# EAGLE schematic Resistor_Resistor (EAGLE 8.3.0), part 6 of 43
## Parts (continued)
R7323  10K  RESISTOR_0201  [0201]
R7324  10K  RESISTOR_0201  [0201]
R7325  10K  RESISTOR_0201  [0201]
R7326  10K  RESISTOR_0201  [0201]
R7327  10K  RESISTOR_0201  [0201]
R7328  10K  RESISTOR_0201  [0201]
R7329  10K  RESISTOR_0201  [0201]
R7330  10K  RESISTOR_0201  [0201]
R7331  10K  RESISTOR_0201  [0201]
R7332  10K  RESISTOR_0201  [0201]
R7333  10K  RESISTOR_0201  [0201]
R7334  10K  RESISTOR_0201  [0201]
R7335  10K  RESISTOR_0201  [0201]
R7336  10K  RESISTOR_0201  [0201]
R7337  10K  RESISTOR_0201  [0201]
R7338  10K  RESISTOR_0201  [0201]
R7339  10K  RESISTOR_0201  [0201]
R7340  10K  RESISTOR_0201  [0201]
R7341  10K  RESISTOR_0201  [0201]
R7342  10K  RESISTOR_0201  [0201]
R7343  10K  RESISTOR_0201  [0201]
R7344  10K  RESISTOR_0201  [0201]
R7345  10K  RESISTOR_0201  [0201]
R7346  10K  RESISTOR_0201  [0201]
R7347  10K  RESISTOR_0201  [0201]
R7348  10K  RESISTOR_0201  [0201]
R7349  10K  RESISTOR_0201  [0201]
R7350  10K  RESISTOR_0201  [0201]
R7351  10K  RESISTOR_0201  [0201]
R7352  10K  RESISTOR_0201  [0201]
R7353  10K  RESISTOR_0201  [0201]
R7354  10K  RESISTOR_0201  [0201]
R7355  10K  RESISTOR_0201  [0201]
R7356  10K  RESISTOR_0201  [0201]
R7357  10K  RESISTOR_0201  [0201]
R7358  10K  RESISTOR_0201  [0201]
R7359  10K  RESISTOR_0201  [0201]
R7360  10K  RESISTOR_0201  [0201]
R7361  10K  RESISTOR_0201  [0201]
R7362  10K  RESISTOR_0201  [0201]
R7363  10K  RESISTOR_0201  [0201]
R7364  10K  RESISTOR_0201  [0201]
R7365  10K  RESISTOR_0201  [0201]
R7366  10K  RESISTOR_0201  [0201]
R7367  10K  RESISTOR_0201  [0201]
R7368  10K  RESISTOR_0201  [0201]
R7369  10K  RESISTOR_0201  [0201]
R7370  10K  RESISTOR_0201  [0201]
R7371  10K  RESISTOR_0201  [0201]
R7372  10K  RESISTOR_0201  [0201]
R7373  10K  RESISTOR_0201  [0201]
R7374  10K  RESISTOR_0201  [0201]
R7375  10K  RESISTOR_0201  [0201]
R7376  10K  RESISTOR_0201  [0201]
R7377  10K  RESISTOR_0201  [0201]
R7378  10K  RESISTOR_0201  [0201]
R7379  10K  RESISTOR_0201  [0201]
R7380  10K  RESISTOR_0201  [0201]
R7381  10K  RESISTOR_0201  [0201]
R7382  10K  RESISTOR_0201  [0201]
R7383  10K  RESISTOR_0201  [0201]
R7384  10K  RESISTOR_0201  [0201]
R7385  10K  RESISTOR_0201  [0201]
R7386  10K  RESISTOR_0201  [0201]
R7387  10K  RESISTOR_0201  [0201]
R7388  10K  RESISTOR_0201  [0201]
R7389  10K  RESISTOR_0201  [0201]
R7390  10K  RESISTOR_0201  [0201]
R7391  10K  RESISTOR_0201  [0201]
R7392  10K  RESISTOR_0201  [0201]
R7393  10K  RESISTOR_0201  [0201]
R7394  10K  RESISTOR_0201  [0201]
R7395  10K  RESISTOR_0201  [0201]
R7396  10K  RESISTOR_0201  [0201]
R7397  10K  RESISTOR_0201  [0201]
R7398  10K  RESISTOR_0201  [0201]
R7399  10K  RESISTOR_0201  [0201]
R7400  10K  RESISTOR_0201  [0201]
R7401  10K  RESISTOR_0201  [0201]
R7402  10K  RESISTOR_0201  [0201]
R7403  10K  RESISTOR_0201  [0201]
R7404  10K  RESISTOR_0201  [0201]
R7405  10K  RESISTOR_0201  [0201]
R7406  10K  RESISTOR_0201  [0201]
R7407  10K  RESISTOR_0201  [0201]
R7408  10K  RESISTOR_0201  [0201]
R7409  10K  RESISTOR_0201  [0201]
R7410  10K  RESISTOR_0201  [0201]
R7411  10K  RESISTOR_0201  [0201]
R7412  10K  RESISTOR_0201  [0201]
R7413  10K  RESISTOR_0201  [0201]
R7414  10K  RESISTOR_0201  [0201]
R7415  10K  RESISTOR_0201  [0201]
R7416  10K  RESISTOR_0201  [0201]
R7417  10K  RESISTOR_0201  [0201]
R7418  10K  RESISTOR_0201  [0201]
R7419  10K  RESISTOR_0201  [0201]
R7420  10K  RESISTOR_0201  [0201]
R7421  10K  RESISTOR_0201  [0201]
R7422  10K  RESISTOR_0201  [0201]
R7423  10K  RESISTOR_0201  [0201]
R7424  10K  RESISTOR_0201  [0201]
R7425  10K  RESISTOR_0201  [0201]
R7426  10K  RESISTOR_0201  [0201]
R7427  10K  RESISTOR_0201  [0201]
R7428  10K  RESISTOR_0201  [0201]
R7429  10K  RESISTOR_0201  [0201]
R7430  10K  RESISTOR_0201  [0201]
R7431  10K  RESISTOR_0201  [0201]
R7432  10K  RESISTOR_0201  [0201]
R7433  10K  RESISTOR_0201  [0201]
R7434  10K  RESISTOR_0201  [0201]
R7435  10K  RESISTOR_0201  [0201]
R7436  10K  RESISTOR_0201  [0201]
R7437  10K  RESISTOR_0201  [0201]
R7438  10K  RESISTOR_0201  [0201]
R7439  10K  RESISTOR_0201  [0201]
R7440  10K  RESISTOR_0201  [0201]
R7441  10K  RESISTOR_0201  [0201]
R7442  10K  RESISTOR_0201  [0201]
R7443  10K  RESISTOR_0201  [0201]
R7444  10K  RESISTOR_0201  [0201]
R7445  10K  RESISTOR_0201  [0201]
R7446  10K  RESISTOR_0201  [0201]
R7447  10K  RESISTOR_0201  [0201]
R7448  10K  RESISTOR_0201  [0201]
R7449  10K  RESISTOR_0201  [0201]
R7450  10K  RESISTOR_0201  [0201]
R7451  10K  RESISTOR_0201  [0201]
R7452  10K  RESISTOR_0201  [0201]
R7453  10K  RESISTOR_0201  [0201]
R7454  10K  RESISTOR_0201  [0201]
R7455  10K  RESISTOR_0201  [0201]
R7456  10K  RESISTOR_0201  [0201]
R7457  10K  RESISTOR_0201  [0201]
R7458  10K  RESISTOR_0201  [0201]
R7459  10K  RESISTOR_0201  [0201]
R7460  10K  RESISTOR_0201  [0201]
R7461  10K  RESISTOR_0201  [0201]
R7462  10K  RESISTOR_0201  [0201]
R7463  10K  RESISTOR_0201  [0201]
R7464  10K  RESISTOR_0201  [0201]
R7465  10K  RESISTOR_0201  [0201]
R7466  10K  RESISTOR_0201  [0201]
R7467  10K  RESISTOR_0201  [0201]
R7468  10K  RESISTOR_0201  [0201]
R7469  10K  RESISTOR_0201  [0201]
R7470  10K  RESISTOR_0201  [0201]
R7471  10K  RESISTOR_0201  [0201]
R7472  10K  RESISTOR_0201  [0201]
R7473  10K  RESISTOR_0201  [0201]
R7474  10K  RESISTOR_0201  [0201]
R7475  10K  RESISTOR_0201  [0201]
R7476  10K  RESISTOR_0201  [0201]
R7477  10K  RESISTOR_0201  [0201]
R7478  10K  RESISTOR_0201  [0201]
R7479  10K  RESISTOR_0201  [0201]
R7480  10K  RESISTOR_0201  [0201]
R7481  10K  RESISTOR_0201  [0201]
R7482  10K  RESISTOR_0201  [0201]
R7483  10K  RESISTOR_0201  [0201]
R7484  10K  RESISTOR_0201  [0201]
R7485  10K  RESISTOR_0201  [0201]
R7486  10K  RESISTOR_0201  [0201]
R7487  10K  RESISTOR_0201  [0201]
R7488  10K  RESISTOR_0201  [0201]
R7489  10K  RESISTOR_0201  [0201]
R7490  10K  RESISTOR_0201  [0201]
R7491  10K  RESISTOR_0201  [0201]
R7492  10K  RESISTOR_0201  [0201]
R7493  10K  RESISTOR_0201  [0201]
R7494  10K  RESISTOR_0201  [0201]
R7495  10K  RESISTOR_0201  [0201]
R7496  10K  RESISTOR_0201  [0201]
R7497  10K  RESISTOR_0201  [0201]
R7498  10K  RESISTOR_0201  [0201]
R7499  10K  RESISTOR_0201  [0201]
R7500  10K  RESISTOR_0201  [0201]
R7501  10K  RESISTOR_0201  [0201]
R7502  10K  RESISTOR_0201  [0201]
R7503  10K  RESISTOR_0201  [0201]
R7504  10K  RESISTOR_0201  [0201]
R7505  10K  RESISTOR_0201  [0201]
R7506  10K  RESISTOR_0201  [0201]
R7507  10K  RESISTOR_0201  [0201]
R7508  10K  RESISTOR_0201  [0201]
R7509  10K  RESISTOR_0201  [0201]
R7510  10K  RESISTOR_0201  [0201]
R7511  10K  RESISTOR_0201  [0201]
R7512  10K  RESISTOR_0201  [0201]
R7513  10K  RESISTOR_0201  [0201]
R7514  10K  RESISTOR_0201  [0201]
R7515  10K  RESISTOR_0201  [0201]
R7516  10K  RESISTOR_0201  [0201]
R7517  10K  RESISTOR_0201  [0201]
R7518  10K  RESISTOR_0201  [0201]
R7519  10K  RESISTOR_0201  [0201]
R7520  10K  RESISTOR_0201  [0201]
R7521  10K  RESISTOR_0201  [0201]
R7522  10K  RESISTOR_0201  [0201]
R7523  10K  RESISTOR_0201  [0201]
R7524  10K  RESISTOR_0201  [0201]
R7525  10K  RESISTOR_0201  [0201]
R7526  10K  RESISTOR_0201  [0201]
R7527  10K  RESISTOR_0201  [0201]
R7528  10K  RESISTOR_0201  [0201]
R7529  10K  RESISTOR_0201  [0201]
R7530  10K  RESISTOR_0201  [0201]
R7531  10K  RESISTOR_0201  [0201]
R7532  10K  RESISTOR_0201  [0201]
R7533  10K  RESISTOR_0201  [0201]
R7534  10K  RESISTOR_0201  [0201]
R7535  10K  RESISTOR_0201  [0201]
R7536  10K  RESISTOR_0201  [0201]
R7537  10K  RESISTOR_0201  [0201]
R7538  10K  RESISTOR_0201  [0201]
R7539  10K  RESISTOR_0201  [0201]
R7540  10K  RESISTOR_0201  [0201]
R7541  10K  RESISTOR_0201  [0201]
R7542  10K  RESISTOR_0201  [0201]
R7543  10K  RESISTOR_0201  [0201]
R7544  10K  RESISTOR_0201  [0201]
R7545  10K  RESISTOR_0201  [0201]
R7546  10K  RESISTOR_0201  [0201]
R7547  10K  RESISTOR_0201  [0201]
R7548  10K  RESISTOR_0201  [0201]
R7549  10K  RESISTOR_0201  [0201]
R7550  10K  RESISTOR_0201  [0201]
R7551  10K  RESISTOR_0201  [0201]
R7552  10K  RESISTOR_0201  [0201]
R7553  10K  RESISTOR_0201  [0201]
R7554  10K  RESISTOR_0201  [0201]
R7555  10K  RESISTOR_0201  [0201]
R7556  10K  RESISTOR_0201  [0201]
R7557  10K  RESISTOR_0201  [0201]
R7558  10K  RESISTOR_0201  [0201]
R7559  10K  RESISTOR_0201  [0201]
R7560  10K  RESISTOR_0201  [0201]
R7561  10K  RESISTOR_0201  [0201]
R7562  10K  RESISTOR_0201  [0201]
R7563  10K  RESISTOR_0201  [0201]
R7564  10K  RESISTOR_0201  [0201]
R7565  10K  RESISTOR_0201  [0201]
R7566  10K  RESISTOR_0201  [0201]
R7567  10K  RESISTOR_0201  [0201]
R7568  10K  RESISTOR_0201  [0201]
R7569  10K  RESISTOR_0201  [0201]
R7570  10K  RESISTOR_0201  [0201]
R7571  10K  RESISTOR_0201  [0201]
R7572  10K  RESISTOR_0201  [0201]
R7573  10K  RESISTOR_0201  [0201]
R7574  10K  RESISTOR_0201  [0201]
R7575  10K  RESISTOR_0201  [0201]
R7576  10K  RESISTOR_0201  [0201]
R7577  10K  RESISTOR_0201  [0201]
R7578  10K  RESISTOR_0201  [0201]
R7579  10K  RESISTOR_0201  [0201]
R7580  10K  RESISTOR_0201  [0201]
R7581  10K  RESISTOR_0201  [0201]
R7582  10K  RESISTOR_0201  [0201]
R7583  10K  RESISTOR_0201  [0201]
R7584  10K  RESISTOR_0201  [0201]
R7585  10K  RESISTOR_0201  [0201]
R7586  10K  RESISTOR_0201  [0201]
R7587  10K  RESISTOR_0201  [0201]
R7588  10K  RESISTOR_0201  [0201]
R7589  10K  RESISTOR_0201  [0201]
R7590  10K  RESISTOR_0201  [0201]
R7591  10K  RESISTOR_0201  [0201]
R7592  10K  RESISTOR_0201  [0201]
R7593  10K  RESISTOR_0201  [0201]
R7594  10K  RESISTOR_0201  [0201]
R7595  10K  RESISTOR_0201  [0201]
R7596  10K  RESISTOR_0201  [0201]
R7597  10K  RESISTOR_0201  [0201]
R7598  10K  RESISTOR_0201  [0201]
R7599  10K  RESISTOR_0201  [0201]
R7600  10K  RESISTOR_0201  [0201]
R7601  10K  RESISTOR_0201  [0201]
R7602  10K  RESISTOR_0201  [0201]
R7603  10K  RESISTOR_0201  [0201]
R7604  10K  RESISTOR_0201  [0201]
R7605  10K  RESISTOR_0201  [0201]
R7606  10K  RESISTOR_0201  [0201]
R7607  10K  RESISTOR_0201  [0201]
R7608  10K  RESISTOR_0201  [0201]
R7609  10K  RESISTOR_0201  [0201]
R7610  10K  RESISTOR_0201  [0201]
R7611  10K  RESISTOR_0201  [0201]
R7612  10K  RESISTOR_0201  [0201]
R7613  10K  RESISTOR_0201  [0201]
R7614  10K  RESISTOR_0201  [0201]
R7615  10K  RESISTOR_0201  [0201]
R7616  10K  RESISTOR_0201  [0201]
R7617  10K  RESISTOR_0201  [0201]
R7618  10K  RESISTOR_0201  [0201]
R7619  10K  RESISTOR_0201  [0201]
R7620  10K  RESISTOR_0201  [0201]
R7621  10K  RESISTOR_0201  [0201]
R7622  10K  RESISTOR_0201  [0201]
R7623  10K  RESISTOR_0201  [0201]
R7624  10K  RESISTOR_0201  [0201]
R7625  10K  RESISTOR_0201  [0201]
R7626  10K  RESISTOR_0201  [0201]
R7627  10K  RESISTOR_0201  [0201]
R7628  10K  RESISTOR_0201  [0201]
R7629  10K  RESISTOR_0201  [0201]
R7630  10K  RESISTOR_0201  [0201]
R7631  10K  RESISTOR_0201  [0201]
R7632  10K  RESISTOR_0201  [0201]
R7633  10K  RESISTOR_0201  [0201]
R7634  10K  RESISTOR_0201  [0201]
R7635  10K  RESISTOR_0201  [0201]
R7636  10K  RESISTOR_0201  [0201]
R7637  10K  RESISTOR_0201  [0201]
R7638  10K  RESISTOR_0201  [0201]
R7639  10K  RESISTOR_0201  [0201]
R7640  10K  RESISTOR_0201  [0201]
R7641  10K  RESISTOR_0201  [0201]
R7642  10K  RESISTOR_0201  [0201]
R7643  10K  RESISTOR_0201  [0201]
R7644  10K  RESISTOR_0201  [0201]
R7645  10K  RESISTOR_0201  [0201]
R7646  10K  RESISTOR_0201  [0201]
R7647  10K  RESISTOR_0201  [0201]
R7648  10K  RESISTOR_0201  [0201]
R7649  10K  RESISTOR_0201  [0201]
R7650  10K  RESISTOR_0201  [0201]
R7651  10K  RESISTOR_0201  [0201]
R7652  10K  RESISTOR_0201  [0201]
R7653  10K  RESISTOR_0201  [0201]
R7654  10K  RESISTOR_0201  [0201]
R7655  10K  RESISTOR_0201  [0201]
R7656  10K  RESISTOR_0201  [0201]
R7657  10K  RESISTOR_0201  [0201]
R7658  10K  RESISTOR_0201  [0201]
R7659  10K  RESISTOR_0201  [0201]
R7660  10K  RESISTOR_0201  [0201]
R7661  10K  RESISTOR_0201  [0201]
R7662  10K  RESISTOR_0201  [0201]
R7663  10K  RESISTOR_0201  [0201]
R7664  10K  RESISTOR_0201  [0201]
R7665  10K  RESISTOR_0201  [0201]
R7666  10K  RESISTOR_0201  [0201]
R7667  10K  RESISTOR_0201  [0201]
R7668  10K  RESISTOR_0201  [0201]
R7669  10K  RESISTOR_0201  [0201]
R7670  10K  RESISTOR_0201  [0201]
R7671  10K  RESISTOR_0201  [0201]
R7672  10K  RESISTOR_0201  [0201]
R7673  10K  RESISTOR_0201  [0201]
R7674  10K  RESISTOR_0201  [0201]
R7675  10K  RESISTOR_0201  [0201]
R7676  10K  RESISTOR_0201  [0201]
R7677  10K  RESISTOR_0201  [0201]
R7678  10K  RESISTOR_0201  [0201]
R7679  10K  RESISTOR_0201  [0201]
R7680  10K  RESISTOR_0201  [0201]
R7681  10K  RESISTOR_0201  [0201]
R7682  10K  RESISTOR_0201  [0201]
R7683  10K  RESISTOR_0201  [0201]
R7684  10K  RESISTOR_0201  [0201]
R7685  10K  RESISTOR_0201  [0201]
R7686  10K  RESISTOR_0201  [0201]
R7687  10K  RESISTOR_0201  [0201]
R7688  10K  RESISTOR_0201  [0201]
R7689  10K  RESISTOR_0201  [0201]
R7690  10K  RESISTOR_0201  [0201]
R7691  10K  RESISTOR_0201  [0201]
R7692  10K  RESISTOR_0201  [0201]
R7693  10K  RESISTOR_0201  [0201]
R7694  10K  RESISTOR_0201  [0201]
R7695  10K  RESISTOR_0201  [0201]
R7696  10K  RESISTOR_0201  [0201]
R7697  10K  RESISTOR_0201  [0201]
R7698  10K  RESISTOR_0201  [0201]
R7699  10K  RESISTOR_0201  [0201]
R7700  10K  RESISTOR_0201  [0201]
R7701  10K  RESISTOR_0201  [0201]
R7702  10K  RESISTOR_0201  [0201]
R7703  10K  RESISTOR_0201  [0201]
R7704  10K  RESISTOR_0201  [0201]
R7705  10K  RESISTOR_0201  [0201]
R7706  10K  RESISTOR_0201  [0201]
R7707  10K  RESISTOR_0201  [0201]
R7708  10K  RESISTOR_0201  [0201]
R7709  10K  RESISTOR_0201  [0201]
R7710  10K  RESISTOR_0201  [0201]
R7711  10K  RESISTOR_0201  [0201]
R7712  10K  RESISTOR_0201  [0201]
R7713  10K  RESISTOR_0201  [0201]
R7714  10K  RESISTOR_0201  [0201]
R7715  10K  RESISTOR_0201  [0201]
R7716  10K  RESISTOR_0201  [0201]
R7717  10K  RESISTOR_0201  [0201]
R7718  10K  RESISTOR_0201  [0201]
R7719  10K  RESISTOR_0201  [0201]
R7720  10K  RESISTOR_0201  [0201]
R7721  10K  RESISTOR_0201  [0201]
R7722  10K  RESISTOR_0201  [0201]
R7723  10K  RESISTOR_0201  [0201]
R7724  10K  RESISTOR_0201  [0201]
R7725  10K  RESISTOR_0201  [0201]
R7726  10K  RESISTOR_0201  [0201]
R7727  10K  RESISTOR_0201  [0201]
R7728  10K  RESISTOR_0201  [0201]
R7729  10K  RESISTOR_0201  [0201]
R7730  10K  RESISTOR_0201  [0201]
R7731  10K  RESISTOR_0201  [0201]
R7732  10K  RESISTOR_0201  [0201]
R7733  10K  RESISTOR_0201  [0201]
R7734  10K  RESISTOR_0201  [0201]
R7735  10K  RESISTOR_0201  [0201]
R7736  10K  RESISTOR_0201  [0201]
R7737  10K  RESISTOR_0201  [0201]
R7738  10K  RESISTOR_0201  [0201]
R7739  10K  RESISTOR_0201  [0201]
R7740  10K  RESISTOR_0201  [0201]
R7741  10K  RESISTOR_0201  [0201]
R7742  10K  RESISTOR_0201  [0201]
R7743  10K  RESISTOR_0201  [0201]
R7744  10K  RESISTOR_0201  [0201]
R7745  10K  RESISTOR_0201  [0201]
R7746  10K  RESISTOR_0201  [0201]
R7747  10K  RESISTOR_0201  [0201]
R7748  10K  RESISTOR_0201  [0201]
R7749  10K  RESISTOR_0201  [0201]
R7750  10K  RESISTOR_0201  [0201]
R7751  10K  RESISTOR_0201  [0201]
R7752  10K  RESISTOR_0201  [0201]
R7753  10K  RESISTOR_0201  [0201]
R7754  10K  RESISTOR_0201  [0201]
R7755  10K  RESISTOR_0201  [0201]
R7756  10K  RESISTOR_0201  [0201]
R7757  10K  RESISTOR_0201  [0201]
R7758  10K  RESISTOR_0201  [0201]
R7759  10K  RESISTOR_0201  [0201]
R7760  10K  RESISTOR_0201  [0201]
R7761  10K  RESISTOR_0201  [0201]
R7762  10K  RESISTOR_0201  [0201]
R7763  10K  RESISTOR_0201  [0201]
R7764  10K  RESISTOR_0201  [0201]
R7765  10K  RESISTOR_0201  [0201]
R7766  10K  RESISTOR_0201  [0201]
R7767  10K  RESISTOR_0201  [0201]
R7768  10K  RESISTOR_0201  [0201]
R7769  10K  RESISTOR_0201  [0201]
R7770  10K  RESISTOR_0201  [0201]
R7771  10K  RESISTOR_0201  [0201]
R7772  10K  RESISTOR_0201  [0201]
R7773  10K  RESISTOR_0201  [0201]
R7774  10K  RESISTOR_0201  [0201]
R7775  10K  RESISTOR_0201  [0201]
R7776  10K  RESISTOR_0201  [0201]
R7777  10K  RESISTOR_0201  [0201]
R7778  10K  RESISTOR_0201  [0201]
R7779  10K  RESISTOR_0201  [0201]
R7780  10K  RESISTOR_0201  [0201]
R7781  10K  RESISTOR_0201  [0201]
R7782  10K  RESISTOR_0201  [0201]
R7783  10K  RESISTOR_0201  [0201]
R7784  10K  RESISTOR_0201  [0201]
R7785  10K  RESISTOR_0201  [0201]
R7786  10K  RESISTOR_0201  [0201]
R7787  10K  RESISTOR_0201  [0201]
R7788  10K  RESISTOR_0201  [0201]
R7789  10K  RESISTOR_0201  [0201]
R7790  10K  RESISTOR_0201  [0201]
R7791  10K  RESISTOR_0201  [0201]
R7792  10K  RESISTOR_0201  [0201]
R7793  10K  RESISTOR_0201  [0201]
R7794  10K  RESISTOR_0201  [0201]
R7795  10K  RESISTOR_0201  [0201]
R7796  10K  RESISTOR_0201  [0201]
R7797  10K  RESISTOR_0201  [0201]
R7798  10K  RESISTOR_0201  [0201]
R7799  10K  RESISTOR_0201  [0201]
R7800  10K  RESISTOR_0201  [0201]
R7801  10K  RESISTOR_0201  [0201]
R7802  10K  RESISTOR_0201  [0201]
R7803  10K  RESISTOR_0201  [0201]
R7804  10K  RESISTOR_0201  [0201]
R7805  10K  RESISTOR_0201  [0201]
R7806  10K  RESISTOR_0201  [0201]
R7807  10K  RESISTOR_0201  [0201]
R7808  10K  RESISTOR_0201  [0201]
R7809  10K  RESISTOR_0201  [0201]
R7810  10K  RESISTOR_0201  [0201]
R7811  10K  RESISTOR_0201  [0201]
R7812  10K  RESISTOR_0201  [0201]
R7813  10K  RESISTOR_0201  [0201]
R7814  10K  RESISTOR_0201  [0201]
R7815  10K  RESISTOR_0201  [0201]
R7816  10K  RESISTOR_0201  [0201]
R7817  10K  RESISTOR_0201  [0201]
R7818  10K  RESISTOR_0201  [0201]
R7819  10K  RESISTOR_0201  [0201]
R7820  10K  RESISTOR_0201  [0201]
R7821  10K  RESISTOR_0201  [0201]
R7822  10K  RESISTOR_0201  [0201]
R7823  10K  RESISTOR_0201  [0201]
R7824  10K  RESISTOR_0201  [0201]
R7825  10K  RESISTOR_0201  [0201]
R7826  10K  RESISTOR_0201  [0201]
R7827  10K  RESISTOR_0201  [0201]
R7828  10K  RESISTOR_0201  [0201]
R7829  10K  RESISTOR_0201  [0201]
R7830  10K  RESISTOR_0201  [0201]
R7831  10K  RESISTOR_0201  [0201]
R7832  10K  RESISTOR_0201  [0201]
R7833  10K  RESISTOR_0201  [0201]
R7834  10K  RESISTOR_0201  [0201]
R7835  10K  RESISTOR_0201  [0201]
R7836  10K  RESISTOR_0201  [0201]
R7837  10K  RESISTOR_0201  [0201]
R7838  10K  RESISTOR_0201  [0201]
R7839  10K  RESISTOR_0201  [0201]
R7840  10K  RESISTOR_0201  [0201]
R7841  10K  RESISTOR_0201  [0201]
R7842  10K  RESISTOR_0201  [0201]
R7843  10K  RESISTOR_0201  [0201]
R7844  10K  RESISTOR_0201  [0201]
R7845  10K  RESISTOR_0201  [0201]
R7846  10K  RESISTOR_0201  [0201]
R7847  10K  RESISTOR_0201  [0201]
R7848  10K  RESISTOR_0201  [0201]
R7849  10K  RESISTOR_0201  [0201]
R7850  10K  RESISTOR_0201  [0201]
R7851  10K  RESISTOR_0201  [0201]
R7852  10K  RESISTOR_0201  [0201]
R7853  10K  RESISTOR_0201  [0201]
R7854  10K  RESISTOR_0201  [0201]
R7855  10K  RESISTOR_0201  [0201]
R7856  10K  RESISTOR_0201  [0201]
R7857  10K  RESISTOR_0201  [0201]
R7858  10K  RESISTOR_0201  [0201]
R7859  10K  RESISTOR_0201  [0201]
R7860  10K  RESISTOR_0201  [0201]
R7861  10K  RESISTOR_0201  [0201]
R7862  10K  RESISTOR_0201  [0201]
R7863  10K  RESISTOR_0201  [0201]
R7864  10K  RESISTOR_0201  [0201]
R7865  10K  RESISTOR_0201  [0201]
R7866  10K  RESISTOR_0201  [0201]
R7867  10K  RESISTOR_0201  [0201]
R7868  10K  RESISTOR_0201  [0201]
R7869  10K  RESISTOR_0201  [0201]
R7870  10K  RESISTOR_0201  [0201]
R7871  10K  RESISTOR_0201  [0201]
R7872  10K  RESISTOR_0201  [0201]
R7873  10K  RESISTOR_0201  [0201]
R7874  10K  RESISTOR_0201  [0201]
R7875  10K  RESISTOR_0201  [0201]
R7876  10K  RESISTOR_0201  [0201]
R7877  10K  RESISTOR_0201  [0201]
R7878  10K  RESISTOR_0201  [0201]
R7879  10K  RESISTOR_0201  [0201]
R7880  10K  RESISTOR_0201  [0201]
R7881  10K  RESISTOR_0201  [0201]
R7882  10K  RESISTOR_0201  [0201]
R7883  10K  RESISTOR_0201  [0201]
R7884  10K  RESISTOR_0201  [0201]
R7885  10K  RESISTOR_0201  [0201]
R7886  10K  RESISTOR_0201  [0201]
R7887  10K  RESISTOR_0201  [0201]
R7888  10K  RESISTOR_0201  [0201]
R7889  10K  RESISTOR_0201  [0201]
R7890  10K  RESISTOR_0201  [0201]
R7891  10K  RESISTOR_0201  [0201]
R7892  10K  RESISTOR_0201  [0201]
R7893  10K  RESISTOR_0201  [0201]
R7894  10K  RESISTOR_0201  [0201]
R7895  10K  RESISTOR_0201  [0201]
R7896  10K  RESISTOR_0201  [0201]
R7897  10K  RESISTOR_0201  [0201]
R7898  10K  RESISTOR_0201  [0201]
R7899  10K  RESISTOR_0201  [0201]
R7900  10K  RESISTOR_0201  [0201]
R7901  10K  RESISTOR_0201  [0201]
R7902  10K  RESISTOR_0201  [0201]
R7903  10K  RESISTOR_0201  [0201]
R7904  10K  RESISTOR_0201  [0201]
R7905  10K  RESISTOR_0201  [0201]
R7906  10K  RESISTOR_0201  [0201]
R7907  10K  RESISTOR_0201  [0201]
R7908  10K  RESISTOR_0201  [0201]
R7909  10K  RESISTOR_0201  [0201]
R7910  10K  RESISTOR_0201  [0201]
R7911  10K  RESISTOR_0201  [0201]
R7912  10K  RESISTOR_0201  [0201]
R7913  10K  RESISTOR_0201  [0201]
R7914  10K  RESISTOR_0201  [0201]
R7915  10K  RESISTOR_0201  [0201]
R7916  10K  RESISTOR_0201  [0201]
R7917  10K  RESISTOR_0201  [0201]
R7918  10K  RESISTOR_0201  [0201]
R7919  10K  RESISTOR_0201  [0201]
R7920  10K  RESISTOR_0201  [0201]
R7921  10K  RESISTOR_0201  [0201]
R7922  10K  RESISTOR_0201  [0201]
R7923  10K  RESISTOR_0201  [0201]
R7924  10K  RESISTOR_0201  [0201]
R7925  10K  RESISTOR_0201  [0201]
R7926  10K  RESISTOR_0201  [0201]
R7927  10K  RESISTOR_0201  [0201]
R7928  10K  RESISTOR_0201  [0201]
R7929  10K  RESISTOR_0201  [0201]
R7930  10K  RESISTOR_0201  [0201]
R7931  10K  RESISTOR_0201  [0201]
R7932  10K  RESISTOR_0201  [0201]
R7933  10K  RESISTOR_0201  [0201]
R7934  10K  RESISTOR_0201  [0201]
R7935  10K  RESISTOR_0201  [0201]
R7936  10K  RESISTOR_0201  [0201]
R7937  10K  RESISTOR_0201  [0201]
R7938  10K  RESISTOR_0201  [0201]
R7939  10K  RESISTOR_0201  [0201]
R7940  10K  RESISTOR_0201  [0201]
R7941  10K  RESISTOR_0201  [0201]
R7942  10K  RESISTOR_0201  [0201]
R7943  10K  RESISTOR_0201  [0201]
R7944  10K  RESISTOR_0201  [0201]
R7945  10K  RESISTOR_0201  [0201]
R7946  10K  RESISTOR_0201  [0201]
R7947  10K  RESISTOR_0201  [0201]
R7948  10K  RESISTOR_0201  [0201]
R7949  10K  RESISTOR_0201  [0201]
R7950  10K  RESISTOR_0201  [0201]
R7951  10K  RESISTOR_0201  [0201]
R7952  10K  RESISTOR_0201  [0201]
R7953  10K  RESISTOR_0201  [0201]
R7954  10K  RESISTOR_0201  [0201]
R7955  10K  RESISTOR_0201  [0201]
R7956  10K  RESISTOR_0201  [0201]
R7957  10K  RESISTOR_0201  [0201]
R7958  10K  RESISTOR_0201  [0201]
R7959  10K  RESISTOR_0201  [0201]
R7960  10K  RESISTOR_0201  [0201]
R7961  10K  RESISTOR_0201  [0201]
R7962  10K  RESISTOR_0201  [0201]
R7963  10K  RESISTOR_0201  [0201]
R7964  10K  RESISTOR_0201  [0201]
R7965  10K  RESISTOR_0201  [0201]
R7966  10K  RESISTOR_0201  [0201]
R7967  10K  RESISTOR_0201  [0201]
R7968  10K  RESISTOR_0201  [0201]
R7969  10K  RESISTOR_0201  [0201]
R7970  10K  RESISTOR_0201  [0201]
R7971  10K  RESISTOR_0201  [0201]
R7972  10K  RESISTOR_0201  [0201]
R7973  10K  RESISTOR_0201  [0201]
R7974  10K  RESISTOR_0201  [0201]
R7975  10K  RESISTOR_0201  [0201]
R7976  10K  RESISTOR_0201  [0201]
R7977  10K  RESISTOR_0201  [0201]
R7978  10K  RESISTOR_0201  [0201]
R7979  10K  RESISTOR_0201  [0201]
R7980  10K  RESISTOR_0201  [0201]
R7981  10K  RESISTOR_0201  [0201]
R7982  10K  RESISTOR_0201  [0201]
R7983  10K  RESISTOR_0201  [0201]
R7984  10K  RESISTOR_0201  [0201]
R7985  10K  RESISTOR_0201  [0201]
R7986  10K  RESISTOR_0201  [0201]
R7987  10K  RESISTOR_0201  [0201]
R7988  10K  RESISTOR_0201  [0201]
R7989  10K  RESISTOR_0201  [0201]
R7990  10K  RESISTOR_0201  [0201]
R7991  10K  RESISTOR_0201  [0201]
R7992  10K  RESISTOR_0201  [0201]
R7993  10K  RESISTOR_0201  [0201]
R7994  10K  RESISTOR_0201  [0201]
R7995  10K  RESISTOR_0201  [0201]
R7996  10K  RESISTOR_0201  [0201]
R7997  10K  RESISTOR_0201  [0201]
R7998  10K  RESISTOR_0201  [0201]
R7999  10K  RESISTOR_0201  [0201]
R8000  10K  RESISTOR_0201  [0201]
R8001  10K  RESISTOR_0201  [0201]
R8002  10K  RESISTOR_0201  [0201]
R8003  10K  RESISTOR_0201  [0201]
R8004  10K  RESISTOR_0201  [0201]
R8005  10K  RESISTOR_0201  [0201]
R8006  10K  RESISTOR_0201  [0201]
R8007  10K  RESISTOR_0201  [0201]
R8008  10K  RESISTOR_0201  [0201]
R8009  10K  RESISTOR_0201  [0201]
R8010  10K  RESISTOR_0201  [0201]
R8011  10K  RESISTOR_0201  [0201]
R8012  10K  RESISTOR_0201  [0201]
R8013  10K  RESISTOR_0201  [0201]
R8014  10K  RESISTOR_0201  [0201]
R8015  10K  RESISTOR_0201  [0201]
R8016  10K  RESISTOR_0201  [0201]
R8017  10K  RESISTOR_0201  [0201]
R8018  10K  RESISTOR_0201  [0201]
R8019  10K  RESISTOR_0201  [0201]
R8020  10K  RESISTOR_0201  [0201]
R8021  10K  RESISTOR_0201  [0201]
R8022  10K  RESISTOR_0201  [0201]
R8023  10K  RESISTOR_0201  [0201]
R8024  10K  RESISTOR_0201  [0201]
R8025  10K  RESISTOR_0201  [0201]
R8026  10K  RESISTOR_0201  [0201]
R8027  10K  RESISTOR_0201  [0201]
R8028  10K  RESISTOR_0201  [0201]
R8029  10K  RESISTOR_0201  [0201]
R8030  10K  RESISTOR_0201  [0201]
R8031  10K  RESISTOR_0201  [0201]
R8032  10K  RESISTOR_0201  [0201]
R8033  10K  RESISTOR_0201  [0201]
R8034  10K  RESISTOR_0201  [0201]
R8035  10K  RESISTOR_0201  [0201]
R8036  10K  RESISTOR_0201  [0201]
R8037  10K  RESISTOR_0201  [0201]
R8038  10K  RESISTOR_0201  [0201]
R8039  10K  RESISTOR_0201  [0201]
R8040  10K  RESISTOR_0201  [0201]
R8041  10K  RESISTOR_0201  [0201]
R8042  10K  RESISTOR_0201  [0201]
R8043  10K  RESISTOR_0201  [0201]
R8044  10K  RESISTOR_0201  [0201]
R8045  10K  RESISTOR_0201  [0201]
R8046  10K  RESISTOR_0201  [0201]
R8047  10K  RESISTOR_0201  [0201]
R8048  10K  RESISTOR_0201  [0201]
R8049  10K  RESISTOR_0201  [0201]
R8050  10K  RESISTOR_0201  [0201]
R8051  10K  RESISTOR_0201  [0201]
R8052  10K  RESISTOR_0201  [0201]